# EasyEDA Pro project Athena.epro, board PCB (continued)
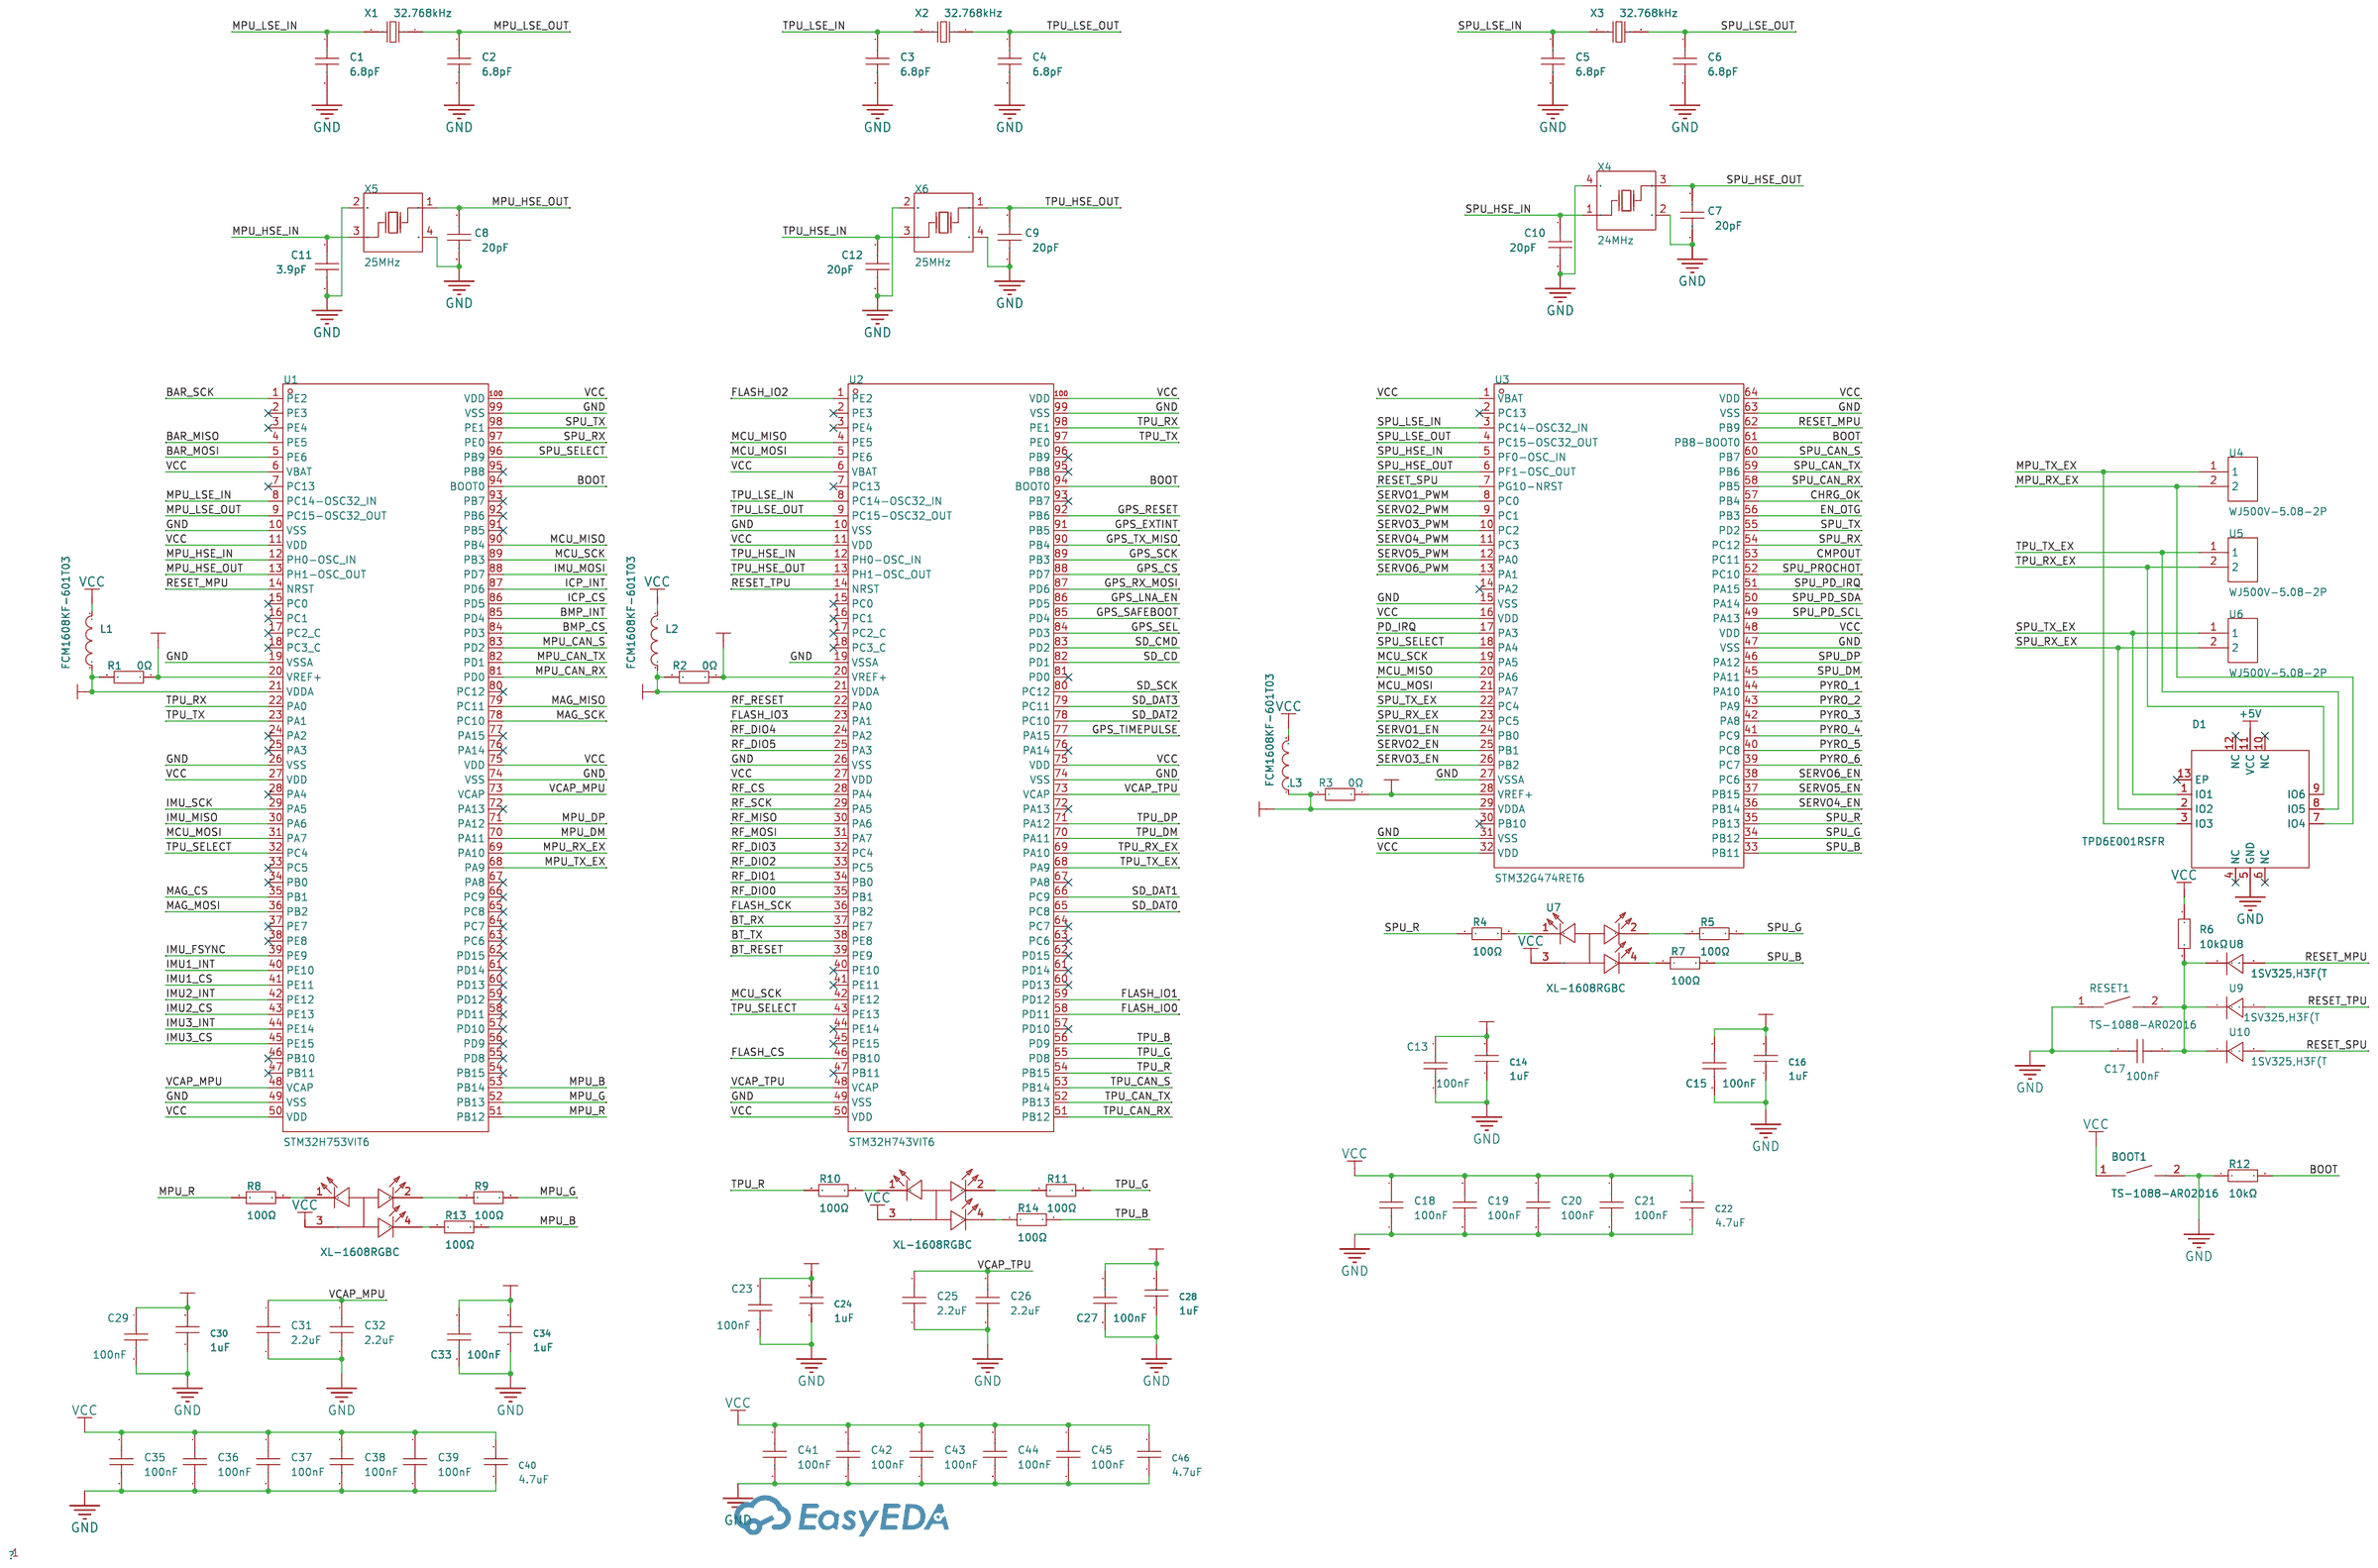
[diagram p0: Processors]
## Routing (per net, layer and track width the routed paths; a pad name or vN(x,y) marks a point on that pad's centre or on a via; arc(x,y) is an arc through that point) (continued)
VBUS: length 5.6
  Top Layer w0.2: v1(41.17,5) v1(41.8,5) 42.14,5.34 42.14,5.62 42.4,5.88 USB1.11 ; USB1.2 37.85,6.13 37.85,5.72 38.2,5.37 v1(38.2,5) v1(38.78,5)
  Bottom Layer w0.2: v1(58.51,35.7) 59.57,35.7 U20.31
  vias: v1(47.4,35.4) v1(48.13,35.4) v1(48.91,35.4) v1(49.7,35.4) v1(50.5,35.4) v1(51.37,35.4) v1(52.2,35.4) v1(53.07,35.4) v1(56.86,36.2) v1(57.2,35.7) v1(57.5,36.2) v1(57.87,35.7) v1(58.21,36.2) v1(58.8,36.2) v1(60,32.1) v1(60.3,31.6) v1(60.6,32.1) v1(60.9,31.6) v1(61.24,32.1)
VCC: length 184.4
  Top Layer w0.2: v1(49.75,45.25) 48.07,46.93 C120.1 48.06,47.03 U25.5 ; v1(53.4,110.6) 53.32,110.52 IMU1.8 ; v1(24.6,109.79) 25.17,109.79 IMU3.8 ; U1.50 30.29,98.89 30.8,98.38 30.85,98.38 v1(31,98.23) ; U1.6 46.8,99.91 v1(46.8,99.48) ; 37.96,46.99 C113.1 ; 37.96,46.99 37.96,48.68 U22.5 ; 37.96,46.99 37.3,47.65 36.9,47.65 v1(36.5,48.05) ; v1(51.9,82.4) 51.87,82.4 U3.1 ; v1(39.4,88.98) 39.4,88.98 38.64,88.21 ; U23.8 v1(50.2,14.9) ; MAG1.5 40.93,70.77 v1(41,70.7) ; v1(44.9,101.58) 44.94,101.58 U1.11 ; v1(46.2,14.95) U23.3 ; 56.22,76.14 56.95,76.87 56.95,77.6 v1(56.8,77.75) ; IMU3.5 27.08,110.68 v1(27.1,110.7) ; v1(28.62,84.8) 29.54,85.71 29.54,85.76 ; v1(38.7,124.4) 39.34,124.4 IMU2.8 ; v1(27.65,86) 27.14,86.51 27.14,86.94 27.57,87.37 ; v1(41.15,41.2) 40.6,40.65 39.88,40.65 R39.2 R38.2 ; v1(38.8,105.58) 38.8,106.51 U1.27 ; U3.64 51.74,83.45 v1(51.8,83.45) ; U12.3 v1(6.38,98.75) ; U1.100 48.6,97.41 v1(48.6,97.68) ; U3.48 58.12,88.65 v1(58.05,88.65) ; IMU1.5 v1(54.2,108.27) ; IMU2.5 41.11,125.25 v1(41.16,125.3) ; v1(21.12,91.3) 20.3,92.12 20.28,92.12 ; MAG1.10 39.46,72.69 v1(39.1,73.05) ; 31.31,81.8 31.31,81.82 v1(30.52,82.6) ; U11.3 41.04,118.56 v1(45.62,118.56) ; U7.3 73.6,96.9 v1(72.7,96.9) ; U26.5 28.25,47.05 28.2,47 v1(28.2,44.85) ; v1(41.9,23.4) U23.25 ; 20.63,73.32 21.62,74.31 v1(21.62,74.4) ; v1(63.15,83.25) 63.15,82.65 U3.32 ; v1(46.95,66.86) C110.1 44.28,66.86 FLASH1.8 ; v1(47.91,14.5) 48.6,15.19 U23.6 ; U23.26 v1(41.9,22.6) ; v1(12.92,83.1) 12.92,83.21 12.14,83.99
  Top Layer w0.4: v2(7.65,131.2) 7.67,131.18 10.62,131.18 11.12,130.68 ; GPS1.22 70.05,132.75 v2(68.3,132.75) ; v2(68.3,133.7) 70,133.7 GPS1.23
  Bottom Layer w0.2: v1(41,70.7) 41.66,70.7 C129.2 ; C38.1 31,97.86 v1(31,98.23) ; v1(62.3,20.6) 62.3,19.92 Q3.3 ; U28.10 37.89,79.64 ; U28.10 U28.9 39.71,79.85 39.82,79.73 ; U28.10 37.9,80.96 C139.1 ; 37.89,79.64 38.41,79.64 v1(38.65,79.4) ; 37.89,79.64 C138.1 ; v1(32.88,67.55) R54.2 v1(32.88,63.05) ; C115.1 41.9,24.47 v1(41.9,23.4) v1(41.9,22.6) ; v1(46.45,14) C69.1 42.66,13.9 R31.1 41.53,13.23 D2.10 ; v1(51.8,83.45) 51.9,83.55 C19.1 ; L1.2 39.2,105.18 v1(38.8,105.58) 38,104.78 C40.2 ; v1(46.8,99.48) 45.96,99.48 C36.1 ; R6.2 62.85,64.95 v1(64.14,66.24) ; v1(12.92,83.1) 13.04,83.1 C41.1 ; L3.2 63.02,84.2 C22.2 63.15,84.07 v1(63.15,83.25) ; C39.1 44.9,101.04 v1(44.9,101.58) ; v1(28.4,59.41) 26.51,59.41 BOOT1.1 ; v1(46.95,66.86) 46.95,65.62 R58.2 ; v1(27.1,110.7) 27.14,110.74 C134.1 ; R27.2 8.76,61.1 8.2,61.1 8.06,60.96 8.06,60.46 v1(7.75,60.15) ; R85.2 45.69,15.46 v1(46.2,14.95) ; v1(30.52,82.6) 29.72,82.6 C45.1 ; C21.1 56.8,78.15 v1(56.8,77.75) ; v1(21.12,91.3) 20.74,91.3 C46.2 19.94,90.5 L2.2 ; C44.1 28.29,85.13 v1(28.62,84.8) ; R102.2 v1(19.95,103) ; v1(53.4,110.6) 53.4,111.09 C128.1 ; C133.1 38.53,124.4 v1(38.7,124.4) ; v1(24.6,109.79) 24.3,110.09 C135.1 ; 58.3,18.85 58.31,18.85 Q4.3 ; v1(54.2,108.27) 54.9,108.27 C127.1 ; C42.1 21.83,74.61 v1(21.62,74.4) ; C43.1 26.56,86 v1(27.65,86) ; C131.1 v1(41.16,125.3) ; v1(38.45,73.45) 38.45,74.55 C130.1 38.6,75.02 U27.1 39.48,75.16 U27.10 39.48,73.92 C132.2 39.44,73.39 v1(39.1,73.05) 38.45,72.4 C126.2 ; R103.2 v1(19.95,101.8) ; C18.1 57.78,88.38 v1(58.05,88.65) ; R57.2 v1(47.17,61.15) ; R45.2 v1(33.56,36) ; C35.1 48.28,98 v1(48.6,97.68) ; v1(51.9,82.4) 52.75,82.4 C20.1 ; R40.2 32.85,36.78 v1(32.85,36) ; U20.38 59.6,38.47 C87.1 59.21,41.14 v1(58.55,41.14) ; R101.2 v1(19.95,104.3) ; v1(39.4,88.98) 40.63,90.2 C37.1
  Bottom Layer w0.4: R98.2 R99.2 R100.2 18.13,107.58 17.98,107.43 v2(16.49,107.43) 15.08,107.43 CARD1.4 ; BOOT1.1 23.23,59.31 L5.2 21.26,64.07 C60.1 21.25,65.98 C61.1 ; U21.J7 v2(67.2,106.03) ; v2(43.85,24.76) 42.89,24.76 C115.1 42.89,25.47 45.88,25.47 48.27,23.08 R90.2 R92.2 ; 39.82,79.73 39.78,79.68 v2(39.78,79)
  vias: v1(18.54,59.54) v1(18.54,58.96) v1(19.14,59.54) v1(19.14,58.96) v1(19.76,59.54) v1(19.76,58.96) v1(20.4,59.55) v1(20.4,58.98) v1(21,59.55) v1(21,58.98) v1(21.62,59.55) v1(21.62,58.98) v1(58.3,18.86)
VDDA_BAT: length 19.4
  Top Layer w0.2: 38.41,37.45 38.41,38.72 37.08,40.05 37.08,40.48 36.41,41.15 v1(36.19,41.15)
  SIGNAL w0.2: v1(36.19,41.15) 35.34,40.3 27.4,40.3 v1(26.3,41.4)
  Bottom Layer w0.2: v1(26.3,41.4) 27.07,41.4 R50.2 ; 35.31,41.27 36.07,41.27 v1(36.19,41.15) 38.06,41.15 C90.1
VDDA_MPU: length 6.8
  Top Layer w0.2: U1.21 41.25,104.96 v1(41.25,104.47)
  Bottom Layer w0.2: 40.65,104.54 L1.1 ; 40.65,104.54 C29.1 C30.2 41.87,101.88 R1.1 ; 40.65,104.54 40.71,104.47 v1(41.25,104.47)
VDDA_SPU: length 7.4
  Top Layer w0.2: v1(62.05,81.55) 62.13,81.55 U3.29
  Bottom Layer w0.2: C14.2 60.21,83.12 C13.1 ; C13.1 60.3,82.95 60.3,81.77 ; C13.1 61.41,83.08 62.05,82.45 v1(62.05,81.55)
VDDA_TPU: length 7.8
  Top Layer w0.2: v1(22.82,90.1) 23.2,90.1 24.16,91.06 24.23,91.06
  Bottom Layer w0.2: R2.1 22.75,89.31 L2.1 ; v1(22.82,90.1) 22.82,90.09 22.82,89.35 ; C23.1 20.96,88.93 L2.1 ; L2.1 22.29,88.36 C24.2
BAR_MISO: length 39.7
  Top Layer w0.2: U1.4 49.51,101.2 50.7,101.2 51.9,100 51.9,93.4 43.7,85.2 43.7,80.78 41.9,78.97 v1(41.9,76.7) 41.9,71.9 41.3,71.3 MAG1.6
  Bottom Layer w0.2: v1(41.9,76.7) 41.85,76.65 U27.5
BAR_MOSI: length 45.3
  Top Layer w0.2: MAG1.4 39.96,70.34 40.3,70 41,70 42.4,71.4 v1(42.4,77.8) 42.4,78.8 44.2,80.6 44.2,85 52.4,93.2 52.4,100.2 50.95,101.65 49.25,101.65 U1.5
  Bottom Layer w0.2: U27.4 39.98,77.08 40.7,77.8 v1(42.4,77.8)
BAR_SCK: length 38
  Top Layer w0.2: MAG1.2 38.8,71.3 38,72.1 38,75.8 v1(38.2,76) 43.2,81 43.2,85.4 51.4,93.6 51.4,99.5 51.1,99.8 50.23,99.8 U1.1
  Bottom Layer w0.2: U27.2 38.23,76.03 v1(38.2,76)
BAT: length 90.2
  POWER w1: ARM1.2 56.56,9.6 48.25,9.6 46.38,7.73 46.38,4.53 45.55,3.7 34.95,3.7 33.35,5.3 33.35,8.59 32.64,9.3 24.1,9.3 22.95,8.15 22.95,4.05 21.7,2.8 13.1,2.8 8.8,7.1 8.8,20.82 U16.1
  Bottom Layer w0.2: 20.37,38.2 20.29,38.28 18.78,38.28 18.74,38.32 R33.2
BMP_CS: length 17.8
  Top Layer w0.2: U1.84 44.6,90.1 v1(44.6,89.6)
  Bottom Layer w0.2: U27.6 42.33,76.03 43.1,76.8 43.1,88.1 v1(44.6,89.6)
BMP_INT: length 19
  Top Layer w0.2: U1.85 45.05,90.36 v1(45.05,90)
  Bottom Layer w0.2: v1(45.05,90) 45.05,89.41 43.5,87.86 43.5,76.6 42.43,75.53 U27.7
BOOT: length 58
  Top Layer w0.2: U3.61 51.98,85.37 v1(51.15,86.2) ; U2.94 32.35,76.5 v1(32.35,76) ; v1(48.7,93.1) 47.22,94.58 47.2,94.58
  SIGNAL w0.2: v1(48.7,93.1) 48.15,92.55 48.15,86.59 37.56,76 v1(32.35,76) 24.65,68.3 v1(24.65,66.15)
  Bottom Layer w0.2: v1(51.15,86.2) 48.7,88.65 v1(48.7,93.1) ; v1(24.65,66.15) 26.38,66.15 R12.2
BT_RESET: length 75
  Top Layer w0.2: 16.01,87.89 13.7,90.19 v1(13.7,90.2)
  Bottom Layer w0.2: v1(13.7,90.2) 13.7,90.3 21.3,97.9 21.3,111.9 23,113.6 60.5,113.6 61.3,114.4 67.13,114.4 U21.J12
BT_RX: length 80.3
  Top Layer w0.2: 16.72,88.59 14.01,91.3 v1(14,91.3)
  Bottom Layer w0.2: U21.J14 70.16,116.04 69.96,116.24 62.34,116.24 60.2,114.1 22.8,114.1 20.8,112.1 20.8,98.1 v1(14,91.3)
BT_TX: length 72.3
  Top Layer w0.2: v1(14.4,90.2) U2.38
  Bottom Layer w0.2: v1(14.4,90.2) 14.4,90.3 21.8,97.7 21.8,111.7 23.2,113.1 60.6,113.1 63.17,110.53 U21.J10
CANH: length 72.5
  Top Layer w0.2: v1(34.5,47.2) 33.9,47.2 ; 33.9,47.2 31.3,47.2 30.79,47.71 U26.7 30.79,49.91 29.8,50.9 9.05,50.9 8.3,51.65 5.05,51.65 4.28,50.88 4.28,49.46 4.42,49.32 C125.2 ; 33.9,47.2 37.45,50.75 39.55,50.75 40.6,49.7 U22.7 ; U25.7 v1(50.6,47.15)
  Top Layer w0.4: C125.2 4.42,45.56 D3.1 5.54,40.36 CAN1.2
  SIGNAL w0.2: v1(50.6,47.15) 50.55,47.2 v1(34.5,47.2)
CANL: length 69.2
  Top Layer w0.2: 8.56,48.22 8.7,48.36 R104.2 8.7,50.05 9.1,50.45 29,50.45 29.52,49.93 U26.6 29.52,47.43 30.2,46.75 34.69,46.75 34.69,46.75 34.85,46.75 v1(34.85,46.75) 35.55,46.05 38.6,46.05 39.33,46.78 U22.6 ; v1(49.35,46.75) 49.33,46.77 U25.6
  Top Layer w0.4: CAN1.1 7.44,36.53 D3.2 8.56,45.56 8.56,48.22
  SIGNAL w0.2: v1(49.35,46.75) 49.3,46.8 34.9,46.8 v1(34.85,46.75)
CHRG_OK: length 61.9
  Top Layer w0.2: 38.08,42.2 38.41,42.53 38.41,42.57 39.64,43.8 41.45,43.8 46.85,49.2 46.85,58 50.55,61.7 50.55,69.4 46.3,73.65 46.3,83.95 50.3,87.95 52.19,87.95 U3.57 ; 38.08,42.2 38.06,42.18 ; 38.08,42.2 v1(37.6,42.2)
  Bottom Layer w0.2: U19.4 37.33,42.47 v1(37.6,42.2)
CMPOUT: length 71.3
  Top Layer w0.2: v1(32.25,38.85) 32.25,39.29 32.91,39.95 34.05,39.95 38.65,44.55 41.05,44.55 46.05,49.55 46.05,58.4 49.75,62.1 49.75,69 45.4,73.35 45.4,84.3 51.1,90 52.97,90 54.8,88.17
  Bottom Layer w0.2: 32.26,39.06 32.26,38.28 R40.1 ; 32.26,39.06 U19.15 ; 32.26,39.06 32.25,39.05 v1(32.25,38.85)
DP0PUR: length 3
  Top Layer w0.2: v1(45.37,21.8) U23.27
  Bottom Layer w0.2: R97.1 45.37,21.06 v1(45.37,21.8)
DRAIN: length 4.6
  Bottom Layer w0.2: U20.30 60.75,35.26 U20.40 62.65,34.5 62.86,34.7 62.86,35.06 63.01,35.21 63.37,35.21 U20.15
EN_OTG: length 64.5
  Top Layer w0.2: U3.56 52.45,88.4 50.1,88.4 45.85,84.15 45.85,73.5 50.15,69.2 50.15,61.9 46.45,58.2 46.45,49.35 41.3,44.2 38.8,44.2 37.1,42.5 v1(37.1,41.9) 37.74,41.26 38.41,41.26
  Bottom Layer w0.2: U19.5 36.93,42.07 v1(37.1,41.9)
FLASH_CS: length 32.4
  Top Layer w0.2: U2.46 14.1,84.84 v1(14.1,84.3) ; R59.1 21.75,66.65 14.1,74.3 v1(14.1,77.3)
  SIGNAL w0.2: v1(14.1,77.3) v1(14.1,84.3)
FLASH_IO0: length 48.1
  Top Layer w0.2: R64.2 48.07,62.07 47.8,61.8 24.1,61.8 12.4,73.5 12.4,77.14 14.59,79.33
FLASH_IO1: length 27.6
  Top Layer w0.2: U2.59 13.5,77.53 13.5,74.1 22.22,65.38 R60.1
FLASH_IO2: length 47.4
  Top Layer w0.2: v1(12.92,76.82) 12.92,73.88 22.69,64.11 R61.1 ; v1(27.65,80.9) 28.19,80.9 31.28,84
  Bottom Layer w0.2: v1(27.65,80.9) 17.06,80.9 12.98,76.82 v1(12.92,76.82)
FLASH_IO3: length 48.7
  Top Layer w0.2: R62.2 48.05,68.2 47.35,68.9 36.6,68.9 33.5,72 33.5,88.35 27.65,94.2 25.93,94.2 U2.23
FLASH_SCK: length 50
  Top Layer w0.2: v1(18.3,87.7) 18.3,87.71 U2.36 ; R63.2 48.51,64.11 48.71,64.31 48.71,68.29 47.6,69.4 36.9,69.4 34.1,72.2 v1(34.1,76.5)
  Bottom Layer w0.2: v1(34.1,76.5) 29.1,81.5 20.1,81.5 18.3,83.3 v1(18.3,87.7)
GPS_CS: length 83.7
  Top Layer w0.2: 70.5,128.3 v1(68.3,128.3) ; 27.06,77.56 27.04,77.56 v1(26.1,78.5)
  SIGNAL w0.2: v1(68.3,128.3) 68.3,128.8 65.8,131.3 55,131.3 25.5,101.8 25.5,79.1 v1(26.1,78.5)
GPS_EXTINT: length 67.3
  Top Layer w0.2: v1(26.8,80) 26.8,79.94 28.12,78.62 ; 58.3,131.6 57.1,131.6 v1(54.6,129.1)
  SIGNAL w0.2: v1(26.8,80) 26.8,101.4 54.5,129.1 v1(54.6,129.1)
GPS_LNA_EN: length 93.2
  Top Layer w0.2: U2.86 25.4,77.79 v1(25.4,77.8) ; 70.5,122 v1(68.9,122)
  SIGNAL w0.2: v1(68.9,122) 68.9,129.94 66.74,132.1 54.6,132.1 24.7,102.2 24.7,78.3 25.25,77.75 25.35,77.75 v1(25.4,77.8)
GPS_RESET: length 63.8
  Top Layer w0.2: 28.48,78.97 27.4,80.05 v1(27.4,80.1) ; 58.3,125.3 v1(56.55,125.3)
  SIGNAL w0.2: v1(56.55,125.3) 51.32,125.3 27.2,101.18 27.2,80.3 v1(27.4,80.1)
GPS_RX_MOSI: length 83.2
  Top Layer w0.2: v1(25.48,78.48) 25.48,78.43 26.71,77.2 ; v1(66.4,131.6) 70.5,131.6
  SIGNAL w0.2: v1(25.48,78.48) 25.1,78.86 25.1,102 54.8,131.7 66.3,131.7 v1(66.4,131.6)
GPS_SAFEBOOT: length 75.4
  Top Layer w0.2: 58.3,134.9 58.25,134.85 v1(56.5,134.85) ; U2.85 23.48,79 v1(23.45,79)
  SIGNAL w0.2: v1(56.5,134.85) 55.6,134.85 23.5,102.75 23.5,79.05 v1(23.45,79)
GPS_SCK: length 81.6
  Top Layer w0.2: 70.5,129.4 70.4,129.5 v1(66.7,129.5) ; 27.42,77.91 26.11,79.22 v1(26.11,79.25)
  SIGNAL w0.2: v1(66.7,129.5) 65.35,130.85 55.15,130.85 25.91,101.61 25.91,79.45 v1(26.11,79.25)
GPS_SEL: length 74.6
  Top Layer w0.2: 58.3,133.8 v1(56.5,133.8) ; 25.65,76.14 23.89,77.9 v1(23.85,77.9)
  SIGNAL w0.2: v1(56.5,133.8) 55.15,133.8 23.9,102.55 23.9,77.9 23.9,77.9 v1(23.85,77.9)
GPS_TIMEPULSE: length 77.8
  Top Layer w0.2: 23.17,73.67 24.1,72.74 v1(24.1,72.7) ; 58.3,132.7 58.2,132.8 v1(56.5,132.8)
  SIGNAL w0.2: v1(56.5,132.8) 54.7,132.8 24.3,102.4 24.3,72.9 v1(24.1,72.7)
GPS_TX_MISO: length 80
  Top Layer w0.2: 27.77,78.27 26.74,79.3 v1(26.7,79.3) ; 70.5,130.5 70.4,130.4 v1(64.9,130.4)
  SIGNAL w0.2: v1(64.9,130.4) 55.26,130.4 26.35,101.49 26.35,79.65 v1(26.7,79.3)
ICP_CS: length 23.7
  Top Layer w0.2: 39.18,71.8 39.7,71.8 v1(39.9,71.6) ; 44.37,91.75 45.5,90.61 v1(45.5,90.34)
  Bottom Layer w0.2: v1(45.5,90.34) 45.5,89.26 43.9,87.66 43.9,75.6 v1(39.9,71.6)
ICP_INT: length 23.2
  Top Layer w0.2: 40.74,71.8 41.1,71.8 v1(41.2,71.9) ; v1(46,90.7) 46,90.82 U1.87
  Bottom Layer w0.2: v1(46,90.7) 45.99,90.69 45.99,89.09 44.3,87.4 44.3,75.4 41.2,72.3 v1(41.2,71.9)
IMU1_CS: length 31
  Top Layer w0.2: v1(31.75,111.64) 31.8,111.59 31.8,103.61 U1.41 ; v1(38.56,111.2) 48.7,111.2 50.63,109.27 IMU1.12
  Bottom Layer w0.2: v1(31.75,111.64) 38.12,111.64 38.55,111.2 v1(38.56,111.2)
IMU1_INT: length 26.8
  Top Layer w0.2: v1(39,108.8) 47.7,108.8 49.8,106.7 52.85,106.7 53.32,107.17 IMU1.4 ; U1.40 32.42,103.7 v1(32.4,103.7)
  Bottom Layer w0.2: v1(32.4,103.7) 32.3,103.8 32.3,104.4 36.7,108.8 v1(39,108.8)
IMU2_CS: length 27.2
  Top Layer w0.2: 32.63,101.36 30.8,103.2 30.8,115.1 37.6,121.9 39.8,121.9 40.11,122.21 IMU2.12
IMU2_INT: length 29.7
  Top Layer w0.2: v1(39.31,121.39) 37.99,121.39 31.3,114.7 31.3,103.4 U1.42 ; v1(42.6,124.4) 42.37,124.4 42.36,124.4 IMU2.4
  Bottom Layer w0.2: v1(42.6,124.4) 42.32,124.4 v1(39.31,121.39)
IMU3_CS: length 9.6
  Top Layer w0.2: U1.45 26.08,106.5 IMU3.12
IMU3_INT: length 11.5
  Top Layer w0.2: U1.44 30.1,103.19 30.1,109.1 29.56,109.64 IMU3.4
IMU_FSYNC: length 55.9
  Top Layer w0.2: IMU3.9 26.16,109.14 v1(26.2,109.1) ; IMU1.9 52.82,110.48 52.26,111.04 49.76,111.04 49.04,111.76 v1(39,111.76) ; IMU2.9 38.79,123.9 30.3,115.4 v1(30.3,112.15) ; 34.04,102.78 32.23,104.6 v1(32.23,112.18)
  Bottom Layer w0.2: v1(26.2,109.1) 29.25,112.15 v1(30.3,112.15) 32.2,112.15 v1(32.23,112.18) 38.58,112.18 v1(39,111.76)
IMU_MISO: length 46.4
  Top Layer w0.2: IMU1.1 51.72,107.4 49.9,107.4 47.9,109.4 38.3,109.4 v1(37.2,108.3) 37.18,108.32 v1(37.18,110.52) 37.18,117.08 41.87,121.77 IMU2.1 ; v1(28.68,108.56) 28.6,108.56 28.17,108.14 IMU3.1 ; U1.30 35.9,107.29 v1(35.9,107.3)
  Bottom Layer w0.2: v1(28.68,108.56) 33.76,108.56 35.72,110.52 v1(37.18,110.52) ; v1(37.2,108.3) 36.9,108.3 v1(35.9,107.3)
IMU_MOSI: length 61.9
  Top Layer w0.2: U1.88 44.33,93.2 v1(44.3,93.2) ; v1(37.66,110) 48.2,110 49.94,108.27 IMU1.14 ; v1(27.45,107.5) 27.45,107.51 IMU3.14 ; IMU2.14 41.11,121.71 36.7,117.3 v1(36.7,110) 36.7,107.9 v1(37,107.6)
  Bottom Layer w0.2: v1(44.3,93.2) 37,100.5 v1(37,107.6) ; v1(27.45,107.5) 33.6,107.5 36.1,110 v1(36.7,110) 37.65,110 v1(37.66,110)
IMU_SCK: length 47
  Top Layer w0.2: IMU1.13 50.24,108.76 48.4,110.6 v1(39.1,110.6) ; IMU3.13 26.58,106.92 v1(26.6,106.9) ; U1.29 36.2,107.7 v1(36.2,109.2) 36.2,117.5 40.61,121.91 IMU2.13
  Bottom Layer w0.2: v1(26.6,106.9) 33.9,106.9 v1(36.2,109.2) 36.4,109.4 37.9,109.4 v1(39.1,110.6)
MAG_CS: length 23.9
  Top Layer w0.2: U1.35 36.35,103.3 v1(36.4,103.3)
  Bottom Layer w0.2: U28.3 40.21,86.29 35.92,90.58 35.92,102.82 v1(36.4,103.3)
MAG_MISO: length 10.3
  Top Layer w0.2: U1.79 42.55,88.62 42.55,87.5 41.4,86.35 v1(41.4,86.25)
  SIGNAL w0.2: v1(41.32,80.53) 41.4,80.61 v1(41.4,86.25)
  Bottom Layer w0.2: v1(41.32,80.53) 40.89,80.96 U28.7
MAG_MOSI: length 23.5
  Top Layer w0.2: v1(36.37,102.63) 35.16,103.84 U1.36
  Bottom Layer w0.2: v1(36.37,102.63) 36.37,90.83 40.71,86.49 U28.4
MAG_SCK: length 7.6
  Top Layer w0.2: U1.78 42.05,88.41 42.05,87.54 v1(39.21,84.7)
  Bottom Layer w0.2: U28.1 v1(39.21,84.7)
MCU_MISO: length 47.4
  Top Layer w0.2: v1(61.08,75.87) 61.06,75.89 61.06,76.26 60.11,77.2 ; v1(32.95,87.75) 32.91,87.75 U2.4 ; v1(47.2,91.7) 45.78,93.12 45.78,93.17 v1(44.8,94.15)
  SIGNAL w0.2: v1(44.8,94.15) 39.35,94.15 v1(32.95,87.75)
  Bottom Layer w0.2: v1(47.2,91.7) 47.2,85.8 57.13,75.87 v1(61.08,75.87)
MCU_MOSI: length 70.2
  Top Layer w0.2: v1(30.55,86.65) 30.55,86.09 U2.5 ; v1(61.7,76.35) 61.67,76.35 60.46,77.56 ; v1(43.1,96.6) 37.65,102.05 37.65,104.83 U1.31 36.87,105.63 v1(35.85,106.65)
  SIGNAL w0.2: v1(35.85,106.65) 33.9,106.65 30.55,103.3 v1(30.55,86.65)
  Bottom Layer w0.2: v1(61.7,76.35) 57.31,76.35 47.75,85.91 47.75,91.95 v1(43.1,96.6)
MCU_SCK: length 65.5
  Top Layer w0.2: v1(34.25,95.8) 42.44,95.8 46.7,91.54 v1(46.7,91.1) ; v1(13.75,88.05) 13.75,88.02 U2.42 ; v1(60.6,75.4) 60.6,76.01 U3.19
  Bottom Layer w0.2: v1(13.75,88.05) 21.5,95.8 v1(34.25,95.8) ; v1(46.7,91.1) 46.7,85.65 56.95,75.4 v1(60.6,75.4)
MPU_B: length 24.4
  Top Layer w0.2: v1(39.83,112.47) 39.29,113.01 39.29,115.75 ; U1.53 32.55,97.68 v1(33.72,97.68)
  GND w0.2: v1(39.83,112.47) 39.83,112.12 39.55,111.84 39.55,103.51 34.54,98.5 34.48,98.5 34.22,98.23 34.22,98.18 v1(33.72,97.68)
MPU_CAN_RX: length 39.4
  Top Layer w0.2: 42.6,89.98 43.25,89.33 43.25,87.46 36.42,80.63 v1(36.42,71.05) ; U22.4 38.06,58.88 v1(36.42,60.52)
  SIGNAL w0.2: v1(36.42,60.52) 36.42,60.52 v1(36.42,71.05)
MPU_CAN_S: length 47.6
  Top Layer w0.2: v1(37.33,71.1) 37.33,80.3 44.1,87.08 44.1,89.9 U1.83 ; v1(37.55,60.81) 42.7,55.66 42.7,49.61 U22.8
  SIGNAL w0.2: v1(37.55,60.81) 37.33,61.03 v1(37.33,71.1)
MPU_CAN_TX: length 41.2
  Top Layer w0.2: U1.82 43.7,89.59 43.7,87.3 36.88,80.47 v1(36.88,71.49) ; v1(36.88,60.85) 36.88,60.79 41.87,55.79 U22.1
  SIGNAL w0.2: v1(36.88,60.85) v1(36.88,71.49)
MPU_DM: length 95.7
  Top Layer w0.2: v1(45.05,32.46) 45.33,32.17 45.33,32.03 46.8,30.56 46.8,30.21 R91.2 46.8,29.32 46.8,28.25 47.2,27.85 49.65,27.85 53.6,23.9 53.6,23.17 53.25,22.82 52.91,22.82 52.68,22.6 U23.15 ; v1(34.77,85.48) 34.77,87.87 U1.70
  SIGNAL w0.2: v1(34.77,85.48) 34.77,81.57 23.4,70.2 23.4,42.56 32.51,33.46 43.95,33.46 44.95,32.46 v1(45.05,32.46)
MPU_DP: length 95.5
  Top Layer w0.2: v1(35.22,86.23) 35.22,87.62 U1.71 ; U23.16 52.68,23.4 52.91,23.18 53.11,23.18 53.25,23.32 53.25,23.75 49.5,27.5 47.05,27.5 46.45,28.1 46.45,29.33 R89.2 46.45,30.22 46.45,30.42 45.08,31.78 44.94,31.78 v1(44.66,32.07)
  SIGNAL w0.2: v1(44.66,32.07) 44.66,32.21 43.76,33.1 32.72,33.1 arc(32.69,33.1) 32.66,33.1 32.5,33.1 arc(32.37,33.13) 32.25,33.2 23,42.45 23,70.4 34.31,81.72 34.31,83.52 34.04,83.79 34.04,85.05 34.31,85.32 34.31,85.67 34.88,86.23 v1(35.22,86.23)
MPU_G: length 25.5
  Top Layer w0.2: v1(34.37,97.69) 33.83,98.23 32.4,98.23 30.56,96.4 30.51,96.4 ; 40.56,115.75 v1(40.56,112.5) ; U1.52 30.51,96.39
  GND w0.2: v1(40.56,112.5) 40.56,112.11 39.9,111.45 39.9,103.22 v1(34.37,97.69)
MPU_HSE_IN: length 5.5
  Top Layer w0.2: v1(46.5,104.5) 46.5,103.85 U1.12
  Bottom Layer w0.2: v1(46.5,104.5) 46.56,104.56 46.56,106.08 46.95,106.08 C11.1
MPU_HSE_OUT: length 8.8
  Top Layer w0.2: 45.08,103.13 46,104.06 46,107 46.9,107.9 v1(46.9,108)
  Bottom Layer w0.2: v1(46.9,108) 46.2,108.7 X5.1 45.04,110 C8.1
MPU_LSE_IN: length 8.8
  Top Layer w0.2: v1(51.7,104.3) 49.78,104.3 46.84,101.36
  Bottom Layer w0.2: C1.1 52.34,103.64 X1.2 52.34,103.66 v1(51.7,104.3)
MPU_LSE_OUT: length 9.1
  Top Layer w0.2: v1(51.4,104.8) 49.57,104.8 U1.9
  Bottom Layer w0.2: v1(51.4,104.8) 50.78,105.42 50.57,105.42 49.31,104.16 C2.1
MPU_R: length 27.2
  Top Layer w0.2: 41.83,115.75 41.83,113.03 v1(41.3,112.5) ; v1(35.01,97.69) 35.01,97.97 34.23,98.75 32.21,98.75 U1.51
  GND w0.2: v1(35.01,97.69) 40.23,102.91 40.23,111.13 41.3,112.2 v1(41.3,112.5)
MPU_RX_EX: length 54.7
  Top Layer w0.2: U1.69 34.31,88.13 34.31,77.53 35.15,76.7 35.15,72.3 v1(35.15,72.3) ; v1(16.8,68.25) 12.25,72.8 v1(11.8,72.8)
  Bottom Layer w0.2: v1(16.8,68.25) 31.1,68.25 v1(35.15,72.3) ; D1.7 v1(11.8,72.8) 8.94,72.8 U4.2
MPU_TX_EX: length 51.7
  Top Layer w0.2: v1(34.7,72.9) 34.7,76.54 33.9,77.34 33.9,88.42 U1.68 ; v1(15.35,69) v1(12.15,69)
  Bottom Layer w0.2: U4.1 7.66,69 v1(12.15,69) D1.3 ; v1(15.35,69) 15.65,68.7 30.91,68.7 34.7,72.49 v1(34.7,72.9)
PD_CC1: length 38.5
  Bottom Layer w0.2: D2.12 51.4,11.6 54.2,14.4 54.2,33.4 54.78,33.98 C91.1 55.87,34.46 U20.28
PD_CC2: length 39.2
  Bottom Layer w0.2: U20.29 56.05,34.86 C89.1 53.8,33.91 53.8,14.6 51.2,12 D2.11
PD_GP1: length 7.8
  Top Layer w0.2: v1(63.2,19.51) v1(57.2,19.51)
  Bottom Layer w0.2: v1(57.2,19.51) 57.6,19.91 58.1,19.91 ; Q3.1 v1(63.2,19.51)
PD_GP2: length 7.9
  Top Layer w0.2: v1(63.3,23.4) v1(57.2,23.4)
  Bottom Layer w0.2: Q6.1 57.94,23.4 v1(57.2,23.4) ; v1(63.3,23.4) 62.87,22.97 Q5.1
PD_IRQ: length 50.9
  Top Layer w0.2: U3.17 59.05,73.29 54.13,68.37 54.13,51.07 65.4,39.8 65.4,34.15 65.05,33.8 v1(64.4,33.8)
  Bottom Layer w0.2: v1(64.4,33.8) 64.37,33.8 64.12,34.06 U20.18
PD_SBU1: length 40.3
  Bottom Layer w0.2: R25.1 60.41,20.73 60.4,20.72 ; R28.2 60.41,22.07 ; 60.4,20.72 60.36,20.77 60.36,28.74 58.5,30.6 58.5,33.2 58.96,33.66 U20.26 ; 60.4,20.72 60.4,18.6 52.2,10.4 D2.15
PD_SBU2: length 40.5
  Bottom Layer w0.2: D2.14 52,10.8 60,18.8 60,22.09 ; 60,22.09 59.98,22.07 R29.2 ; 60,22.09 60,28.5 58.04,30.46 58.04,33.34 58.76,34.06 U20.27 ; R26.1 60,20.65
PD_SCL: length 41.3
  SIGNAL w0.2: v1(32.8,39.2) 32.8,39.44 33,39.64 37.08,39.64 38.13,40.69 63.64,40.69 65.15,39.18 65.15,34.65 v1(64.8,34.3)
  Bottom Layer w0.2: U20.17 64.14,34.46 64.3,34.3 v1(64.8,34.3) ; U19.13 33.06,39.46 v1(32.8,39.2)
PD_SDA: length 39
  SIGNAL w0.2: v1(33.4,39.1) 37.2,39.1 38.4,40.3 63.6,40.3 64.68,39.22 v1(64.68,34.86)
  Bottom Layer w0.2: U20.16 v1(64.68,34.86) ; U19.12 33.41,40.17 33.41,39.82 33.4,39.82 v1(33.4,39.1)
PPHV:
  vias: v1(57.8,48.9) v1(58.15,48.4) v1(58.55,48.9) v1(58.9,48.4) v1(59.3,48.9) v1(59.65,48.4) v1(60.05,48.9) v1(60.4,48.4) v1(60.8,48.9) v1(61.15,48.4) v1(61.55,48.9) v1(61.6,30.2) v1(61.9,48.4) v1(61.9,30.7) v1(62.19,30.2) v1(62.3,48.9) v1(62.44,30.7) v1(62.65,48.4) v1(62.75,30.2) v1(63.03,30.7) v1(63.05,48.9) v1(63.34,30.2) v1(63.4,48.4) v1(63.6,30.7) v1(63.8,48.9) v1(63.9,30.2) v1(64.15,48.4) v1(64.21,30.7) v1(64.53,30.2) v1(64.55,48.9) v1(64.8,30.7) v1(64.9,48.4) v1(65.09,30.2) v1(65.3,48.9) v1(65.39,30.7) v1(65.65,48.4) v1(66.05,48.9) v1(66.4,48.4) v1(66.8,48.9) v1(67.15,48.4) v1(67.55,48.9) v1(67.9,48.4)
PYRO_1: length 97.7
  Top Layer w0.2: v1(62.2,89.9) 62.2,89.9 60.46,88.17
  Bottom Layer w0.2: v1(62.2,89.9) 64.4,92.1 75.8,92.1 79.2,88.7 79.2,21.6 76.54,18.94 R72.1
PYRO_2: length 85.4
  Top Layer w0.2: v1(62.2,89.2) 62.1,89.1 62.1,89.1 60.81,87.81
  Bottom Layer w0.2: R73.1 76.39,29.99 78.8,32.4 78.8,88.5 75.6,91.7 64.7,91.7 v1(62.2,89.2)
PYRO_3: length 73
  Top Layer w0.2: U3.42 61.17,87.48 v1(62.89,89.21)
  Bottom Layer w0.2: R74.1 71.62,41.11 76.41,41.11 78.4,43.1 78.4,88.3 75.4,91.3 64.99,91.3 v1(62.89,89.21)
PYRO_4: length 47
  Top Layer w0.2: U3.41 62.9,88.48 v1(62.9,88.5)
  Bottom Layer w0.2: R75.1 76.39,65.89 78,67.5 78,88.1 75.2,90.9 65.3,90.9 v1(62.9,88.5)
PYRO_5: length 34.7
  Top Layer w0.2: U3.40 61.88,86.78 v1(63.6,88.5)
  Bottom Layer w0.2: v1(63.6,88.5) 65.58,90.48 75.02,90.48 77.6,87.9 77.6,78.28 76.28,76.96 R76.1
PYRO_6: length 11.9
  Top Layer w0.2: v1(63.5,87.7) 62.23,86.43 62.23,86.4
  Bottom Layer w0.2: R77.1 71.47,88.83 70.3,90 65.8,90 v1(63.5,87.7)
REGN: length 22.5
  Top Layer w0.2: v1(31.6,46.15) 31.25,45.8 31.25,37.95 32.44,36.76 39.11,36.76 39.25,36.9 39.25,37.42 R44.1
  Bottom Layer w0.2: v1(31.6,46.15) 31.6,46.54 C85.1 33.06,46.89 U19.28
RESET_MPU: length 50.5
  Top Layer w0.2: v1(48.75,82.95) 52.1,82.95 52.65,83.5 52.65,83.96 U3.62 ; v1(43.25,102) 44.72,103.47 U1.14
  SIGNAL w0.2: v1(45.85,85.99) 47.75,87.89 47.75,97.5 v1(43.25,102)
  Bottom Layer w0.2: v1(48.75,82.95) 47.4,84.3 47.4,84.3 45.85,85.85 v1(45.85,85.99) ; 48.75,82.95 60.18,71.53 U8.2
RESET_SPU: length 20.5
  Top Layer w0.2: U3.7 54.36,80.65 v1(56.55,80.65)
  Bottom Layer w0.2: U10.2 61.48,68.98 62.45,69.95 62.45,76.75 61.5,77.7 59.5,77.7 v1(56.55,80.65)
RESET_TPU: length 47.1
  Top Layer w0.2: v1(27.8,89.7) 26.69,88.59 26.69,88.59
  SIGNAL w0.2: v1(45.46,85.6) 44.07,87 34.7,87 v1(32.95,85.25)
  Bottom Layer w0.2: v1(27.8,89.7) 26.97,88.87 26.97,88.67 30.4,85.25 v1(32.95,85.25) ; v1(45.46,85.6) 45.46,85.57 58.91,72.13 58.91,69.29 58.88,69.26 U9.2
RF_CS: length 45.5
  Top Layer w0.2: v1(19.4,123.9) 19.3,123.8 19.3,92.39 19.92,91.77 ; v1(19.4,126.77) 25.3,132.67 U24.15
  Bottom Layer w0.2: v1(19.4,126.77) v1(19.4,123.9)
RF_DIO0: length 43.1
  Top Layer w0.2: 17.45,89.3 8.3,98.44 8.3,125.2 9.78,126.68 11.12,126.68
RF_DIO1: length 40.5
  Top Layer w0.2: 17.8,89.65 8.86,98.59 8.86,123.76 9.8,124.7 11.1,124.7 11.12,124.68
RF_DIO2: length 37.8
  Top Layer w0.2: 18.15,90 9.4,98.76 9.4,122.3 9.78,122.68 11.12,122.68
RF_DIO3: length 33.4
  Top Layer w0.2: 18.51,90.36 11.12,97.74 11.12,120.68
RF_DIO4: length 33.6
  Top Layer w0.2: 23.17,92.12 24,92.95 24,121.9 24.78,122.68 U24.10
RF_DIO5: length 35.2
  Top Layer w0.2: 22.82,92.48 23.5,93.16 23.5,123.1 25.08,124.68 U24.11
RF_MISO: length 44.3
  Top Layer w0.2: 19.21,91.06 19.21,91.16 18.3,92.08 18.3,124.2 22.88,128.78 27.02,128.78 U24.13